# EasyEDA Pro project YanQi_Project_V2.0.eprj, board BatteryBoard
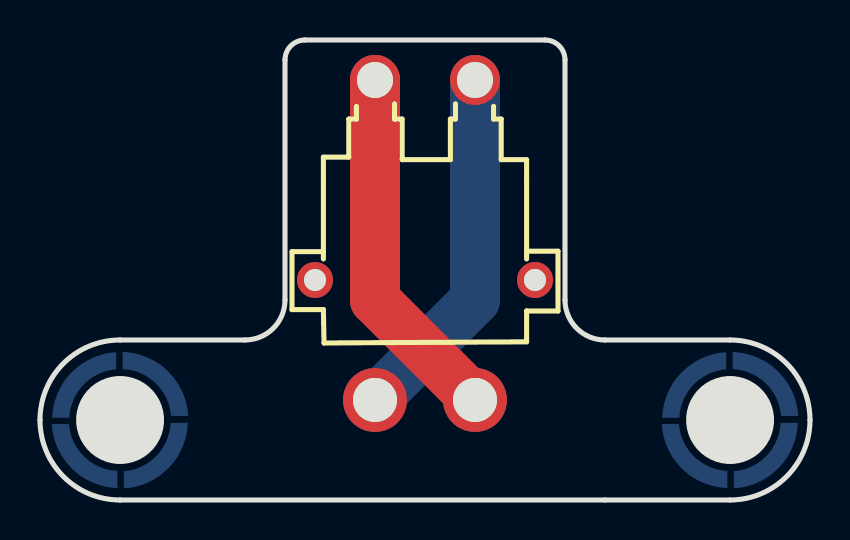
[diagram p8: board, top side]
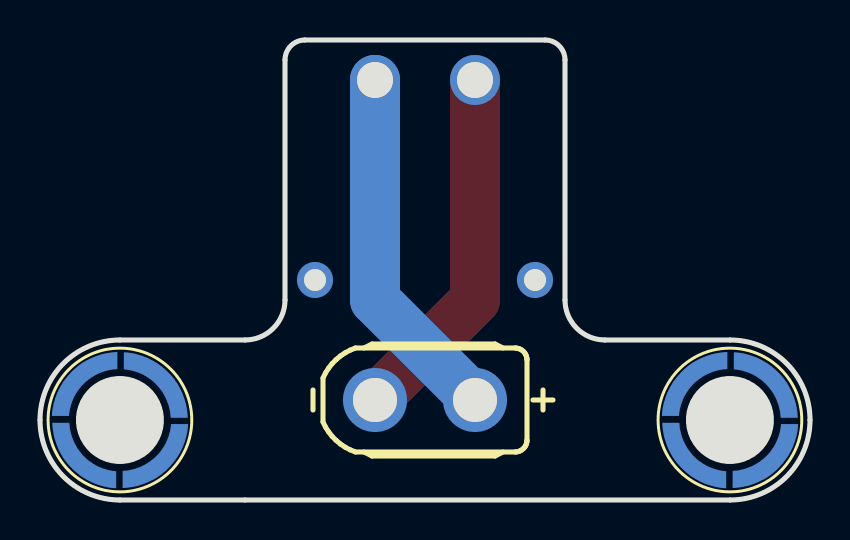
[diagram p9: board, bottom side, seen from below]

Outline 38.5 x 23 mm; copper layers: Top Layer, Bottom Layer. Coordinates in mm from the lower left corner of the outline.
Outline path: 0,4 arc(1.17,6.83) 4,8 10.25,8 arc(11.66,8.59) 12.25,10 12.25,22 arc(12.54,22.71) 13.25,23 25.25,23 arc(25.96,22.71) 26.25,22 26.25,10 arc(26.84,8.59) 28.25,8 34.5,8 arc(37.33,6.83) 38.5,4 arc(37.33,1.17) 34.5,0 28.25,0 4,0 arc(1.17,1.17) 0,4
Stack: Top Layer 0.035mm / Dielectric1 1.51mm FR4 er 4.5 / Bottom Layer 0.035mm

## Design rules (mm)
template: 自定义配置
spacing copperThickness1oz (default): track to track 0.102, other pairs 0.152 to 0.3
spacing copperThickness2oz: track to track 0.203, other pairs 0.152 to 0.3
track width copperThickness1oz (default): min 0.127, default 0.254, max 10
track width copperThickness2oz: min 0.203, default 0.254, max 2.54
differential pair differentialPair (default): width min 0.127, default 0.254, max 2.54; gap min 0.152, default 0.152
via viaSize (default): diameter min 0.5, default 0.61, max 10; hole min 0.3, default 0.305, max 6.3

## Placement (name value [footprint] x y rotation side)
CN1  XT30PW-M  [CONN-TH_XT30PW-M]  19.25 16 0 top
CN2  XT30UPB-F30.G.Y  [CONN-TH_XT30UPB-F]  19.25 5 0 bottom
U33  SMTSO3050CTJ  [SMD_SMTSO3060CTJ]  4 4 180 bottom
U34  SMTSO3050CTJ  [SMD_SMTSO3060CTJ]  34.5 4 180 bottom

## Footprints (pads in the part's own frame, mm; a bottom-side part is the same pattern mirrored in y, then rotated)
CONN-TH_XT30PW-M
  round 2.5 hole 1.8: 1(-2.5,5) 2(2.5,5)
  round 1.8 hole 1.1: 3(5.5,-5) 4(-5.5,-5)
CONN-TH_XT30UPB-F
  round 3.2 hole 2.2: 1(-2.5,0) 2(2.5,0)
SMD_SMTSO3060CTJ
  custom 3.197x3.279 smd: 1(-1.79,-2.369)
  custom 3.279x3.197 smd: 1(-1.769,2.386) 1(1.768,-2.386)
  custom 3.197x3.278 smd: 1(1.79,2.34)

## Nets
As in the schematic.

## Routing (per net, layer and track width the routed paths; a pad name or vN(x,y) marks a point on that pad's centre or on a via; arc(x,y) is an arc through that point)
GND: length 18.1
  Top Layer w2.5: CN1.1 16.75,10 CN2.2
$1N337: length 18.1
  Bottom Layer w2.5: CN2.1 21.75,10 CN1.2
